# Altium schematic sheet SOC_SUP.SchDoc: Title
size 420 x 297 mm; Author: G.Kasprowicz; CompanyName: WUT ISE; DrawnBy: G.Kasprowicz; Organization: WUT ISE; Address1: PW ISE; Address2: Nowowiejska 15/19 00-665 Warsaw; Address3: gkasprow@gmail.com; DocumentNumber: 19; Revision: 2; SheetNumber: 19; SheetTotal: 40; ModifiedBy: -; CheckedDate: -; Title2: Title 2; DivGrp: WUT ISE; Designer: G.Kasprowicz; ModifiedDate: -; ProjectName: Sensor Box
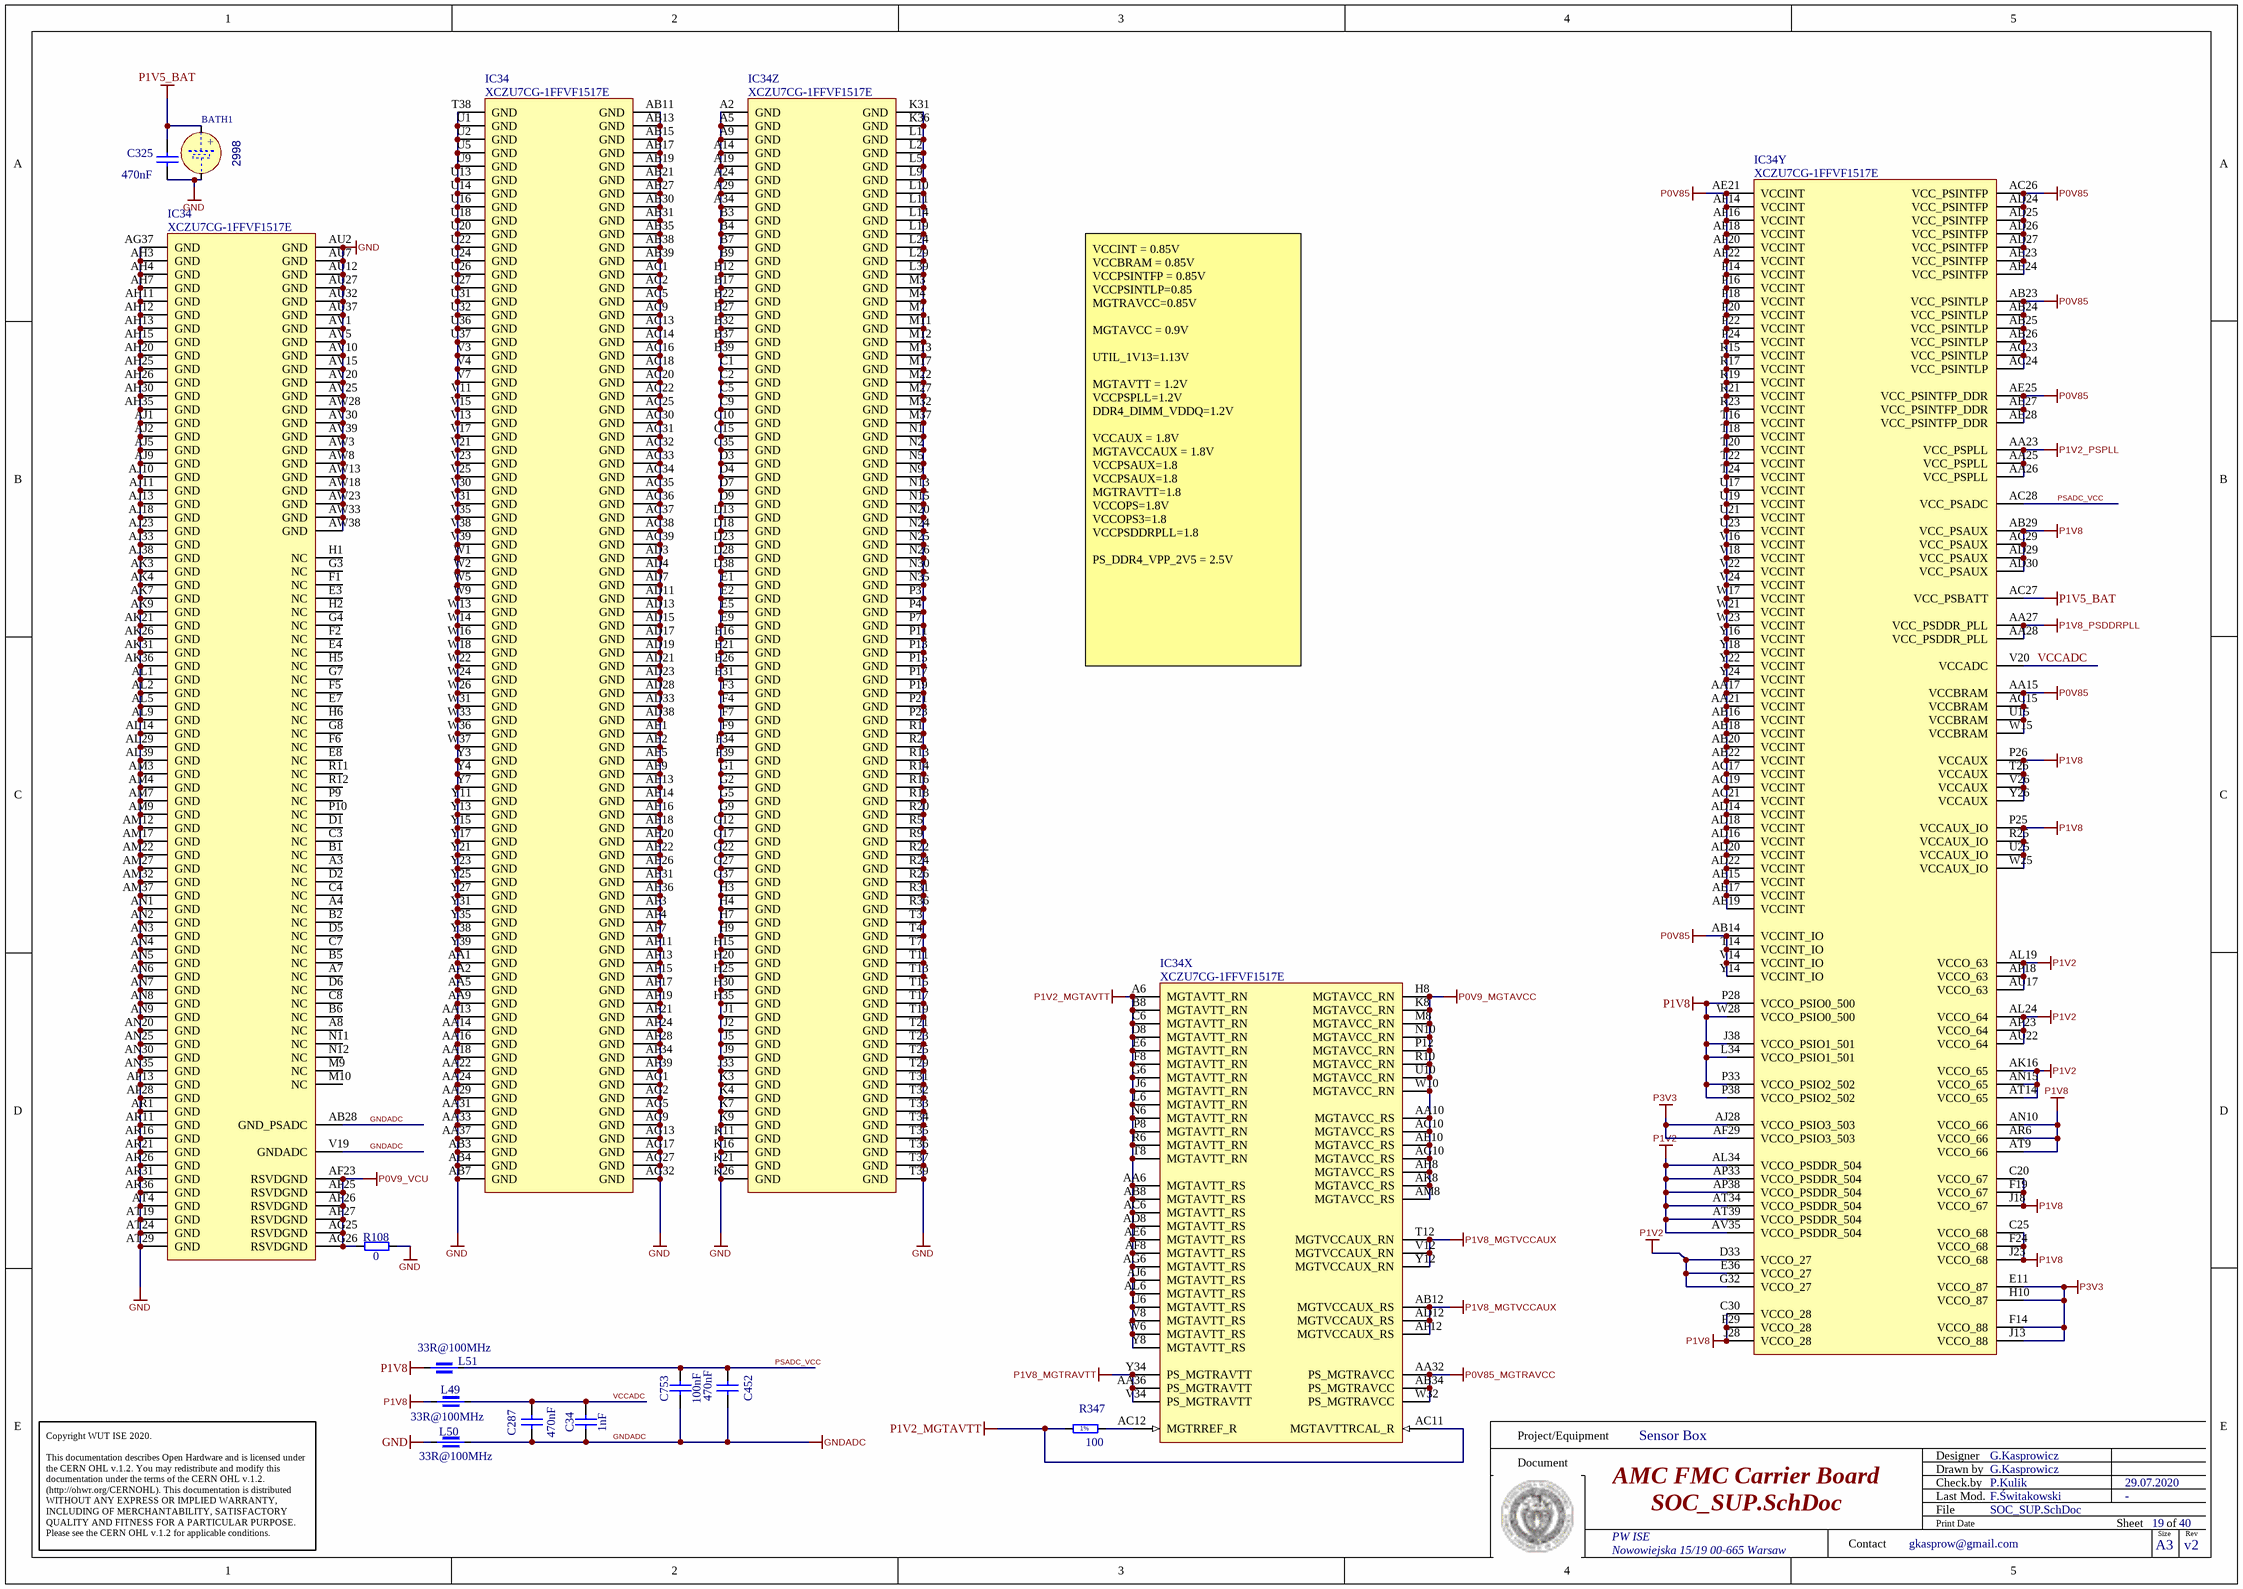
[diagram p0: SOC_SUP.SchDoc]

## Parts
BATH1  Manufacturer Part Number: 2998  [BATH_KEYSTONE_2998]
C34  1nF  [CAPC0603X33N]
C287  470nF  [CAPC0603X33N]
C325  470nF  [CAPC0603X33N]
C452  470nF  [CAPC0603X33N]
C753  100nF  [CAPC1005X55N]
IC34  XCZU7CG-1FFVF1517E  [BGA1517C100P39X39_4000X4000X351]  (parts X,Y,Z,27,28 of 28)
L49  33R@100MHz  [INDC1005X55N]
L50  33R@100MHz  [INDC1005X55N]
L51  33R@100MHz  [INDC1005X55N]
R108  0  [RESC3216X65N]
R347  100  [RESC1005X40N]

## Nets
GND: BATH1.2(MINUS) C325.1 IC34.A2(GND) IC34.A5(GND) IC34.A9(GND) IC34.A14(GND) IC34.A19(GND) IC34.A24(GND) IC34.A29(GND) IC34.A34(GND) IC34.AA1(GND) IC34.AA2(GND) IC34.AA5(GND) IC34.AA9(GND) IC34.AA13(GND) IC34.AA14(GND) IC34.AA16(GND) IC34.AA18(GND) IC34.AA22(GND) IC34.AA24(GND) IC34.AA29(GND) IC34.AA31(GND) IC34.AA33(GND) IC34.AA37(GND) IC34.AB3(GND) IC34.AB4(GND) IC34.AB7(GND) IC34.AB11(GND) IC34.AB13(GND) IC34.AB15(GND) IC34.AB17(GND) IC34.AB19(GND) IC34.AB21(GND) IC34.AB27(GND) IC34.AB30(GND) IC34.AB31(GND) IC34.AB35(GND) IC34.AB38(GND) IC34.AB39(GND) IC34.AC1(GND) IC34.AC2(GND) IC34.AC5(GND) IC34.AC9(GND) IC34.AC13(GND) IC34.AC14(GND) IC34.AC16(GND) IC34.AC18(GND) IC34.AC20(GND) IC34.AC22(GND) IC34.AC25(GND) IC34.AC30(GND) IC34.AC31(GND) IC34.AC32(GND) IC34.AC33(GND) IC34.AC34(GND) IC34.AC35(GND) IC34.AC36(GND) IC34.AC37(GND) IC34.AC38(GND) IC34.AC39(GND) IC34.AD3(GND) IC34.AD4(GND) IC34.AD7(GND) IC34.AD11(GND) IC34.AD13(GND) IC34.AD15(GND) IC34.AD17(GND) IC34.AD19(GND) IC34.AD21(GND) IC34.AD23(GND) IC34.AD28(GND) IC34.AD33(GND) IC34.AD38(GND) IC34.AE1(GND) IC34.AE2(GND) IC34.AE5(GND) IC34.AE9(GND) IC34.AE13(GND) IC34.AE14(GND) IC34.AE16(GND) IC34.AE18(GND) IC34.AE20(GND) IC34.AE22(GND) IC34.AE26(GND) IC34.AE31(GND) IC34.AE36(GND) IC34.AF3(GND) IC34.AF4(GND) IC34.AF7(GND) IC34.AF11(GND) IC34.AF13(GND) IC34.AF15(GND) IC34.AF17(GND) IC34.AF19(GND) IC34.AF21(GND) IC34.AF24(GND) IC34.AF28(GND) IC34.AF34(GND) IC34.AF39(GND) IC34.AG1(GND) IC34.AG2(GND) IC34.AG5(GND) IC34.AG9(GND) IC34.AG13(GND) IC34.AG17(GND) IC34.AG27(GND) IC34.AG32(GND) IC34.AG37(GND) IC34.AH3(GND) IC34.AH4(GND) IC34.AH7(GND) IC34.AH11(GND) IC34.AH12(GND) IC34.AH13(GND) IC34.AH15(GND) IC34.AH20(GND) IC34.AH25(GND) IC34.AH26(GND) IC34.AH30(GND) IC34.AH35(GND) IC34.AJ1(GND) IC34.AJ2(GND) IC34.AJ5(GND) IC34.AJ9(GND) IC34.AJ10(GND) IC34.AJ11(GND) IC34.AJ13(GND) IC34.AJ18(GND) IC34.AJ23(GND) IC34.AJ33(GND) IC34.AJ38(GND) IC34.AK3(GND) IC34.AK4(GND) IC34.AK7(GND) IC34.AK9(GND) IC34.AK21(GND) IC34.AK26(GND) IC34.AK31(GND) IC34.AK36(GND) IC34.AL1(GND) IC34.AL2(GND) IC34.AL5(GND) IC34.AL9(GND) IC34.AL14(GND) IC34.AL29(GND) IC34.AL39(GND) IC34.AM3(GND) IC34.AM4(GND) IC34.AM7(GND) IC34.AM9(GND) IC34.AM12(GND) IC34.AM17(GND) IC34.AM22(GND) IC34.AM27(GND) IC34.AM32(GND) IC34.AM37(GND) IC34.AN1(GND) IC34.AN2(GND) IC34.AN3(GND) IC34.AN4(GND) IC34.AN5(GND) IC34.AN6(GND) IC34.AN7(GND) IC34.AN8(GND) IC34.AN9(GND) IC34.AN20(GND) IC34.AN25(GND) IC34.AN30(GND) IC34.AN35(GND) IC34.AP13(GND) IC34.AP28(GND) IC34.AR1(GND) IC34.AR11(GND) IC34.AR16(GND) IC34.AR21(GND) IC34.AR26(GND) IC34.AR31(GND) IC34.AR36(GND) IC34.AT4(GND) IC34.AT19(GND) IC34.AT24(GND) IC34.AT29(GND) IC34.AU2(GND) IC34.AU7(GND) IC34.AU12(GND) IC34.AU27(GND) IC34.AU32(GND) IC34.AU37(GND) IC34.AV1(GND) IC34.AV5(GND) IC34.AV10(GND) IC34.AV15(GND) IC34.AV20(GND) IC34.AV25(GND) IC34.AV30(GND) IC34.AV39(GND) IC34.AW3(GND) IC34.AW8(GND) IC34.AW13(GND) IC34.AW18(GND) IC34.AW23(GND) IC34.AW28(GND) IC34.AW33(GND) IC34.AW38(GND) IC34.B3(GND) IC34.B4(GND) IC34.B7(GND) IC34.B9(GND) IC34.B12(GND) IC34.B17(GND) IC34.B22(GND) IC34.B27(GND) IC34.B32(GND) IC34.B37(GND) IC34.B39(GND) IC34.C1(GND) IC34.C2(GND) IC34.C5(GND) IC34.C9(GND) IC34.C10(GND) IC34.C15(GND) IC34.C35(GND) IC34.D3(GND) IC34.D4(GND) IC34.D7(GND) IC34.D9(GND) IC34.D13(GND) IC34.D18(GND) IC34.D23(GND) IC34.D28(GND) IC34.D38(GND) IC34.E1(GND) IC34.E2(GND) IC34.E5(GND) IC34.E9(GND) IC34.E16(GND) IC34.E21(GND) IC34.E26(GND) IC34.E31(GND) IC34.F3(GND) IC34.F4(GND) IC34.F7(GND) IC34.F9(GND) IC34.F34(GND) IC34.F39(GND) IC34.G1(GND) IC34.G2(GND) IC34.G5(GND) IC34.G9(GND) IC34.G12(GND) IC34.G17(GND) IC34.G22(GND) IC34.G27(GND) IC34.G37(GND) IC34.H3(GND) IC34.H4(GND) IC34.H7(GND) IC34.H9(GND) IC34.H15(GND) IC34.H20(GND) IC34.H25(GND) IC34.H30(GND) IC34.H35(GND) IC34.J1(GND) IC34.J2(GND) IC34.J5(GND) IC34.J9(GND) IC34.J33(GND) IC34.K3(GND) IC34.K4(GND) IC34.K7(GND) IC34.K9(GND) IC34.K11(GND) IC34.K16(GND) IC34.K21(GND) IC34.K26(GND) IC34.K31(GND) IC34.K36(GND) IC34.L1(GND) IC34.L2(GND) IC34.L5(GND) IC34.L9(GND) IC34.L10(GND) IC34.L11(GND) IC34.L14(GND) IC34.L19(GND) IC34.L24(GND) IC34.L29(GND) IC34.L39(GND) IC34.M3(GND) IC34.M4(GND) IC34.M7(GND) IC34.M11(GND) IC34.M12(GND) IC34.M13(GND) IC34.M17(GND) IC34.M22(GND) IC34.M27(GND) IC34.M32(GND) IC34.M37(GND) IC34.N1(GND) IC34.N2(GND) IC34.N5(GND) IC34.N9(GND) IC34.N13(GND) IC34.N15(GND) IC34.N20(GND) IC34.N24(GND) IC34.N25(GND) IC34.N26(GND) IC34.N30(GND) IC34.N35(GND) IC34.P3(GND) IC34.P4(GND) IC34.P7(GND) IC34.P11(GND) IC34.P13(GND) IC34.P15(GND) IC34.P17(GND) IC34.P19(GND) IC34.P21(GND) IC34.P23(GND) IC34.R1(GND) IC34.R2(GND) IC34.R5(GND) IC34.R9(GND) IC34.R13(GND) IC34.R14(GND) IC34.R16(GND) IC34.R18(GND) IC34.R20(GND) IC34.R22(GND) IC34.R24(GND) IC34.R26(GND) IC34.R31(GND) IC34.R36(GND) IC34.T3(GND) IC34.T4(GND) IC34.T7(GND) IC34.T11(GND) IC34.T13(GND) IC34.T15(GND) IC34.T17(GND) IC34.T19(GND) IC34.T21(GND) IC34.T23(GND) IC34.T25(GND) IC34.T29(GND) IC34.T31(GND) IC34.T32(GND) IC34.T33(GND) IC34.T34(GND) IC34.T35(GND) IC34.T36(GND) IC34.T37(GND) IC34.T38(GND) IC34.T39(GND) IC34.U1(GND) IC34.U2(GND) IC34.U5(GND) IC34.U9(GND) IC34.U13(GND) IC34.U14(GND) IC34.U16(GND) IC34.U18(GND) IC34.U20(GND) IC34.U22(GND) IC34.U24(GND) IC34.U26(GND) IC34.U27(GND) IC34.U31(GND) IC34.U32(GND) IC34.U36(GND) IC34.U37(GND) IC34.V3(GND) IC34.V4(GND) IC34.V7(GND) IC34.V11(GND) IC34.V13(GND) IC34.V15(GND) IC34.V17(GND) IC34.V21(GND) IC34.V23(GND) IC34.V25(GND) IC34.V30(GND) IC34.V31(GND) IC34.V35(GND) IC34.V38(GND) IC34.V39(GND) IC34.W1(GND) IC34.W2(GND) IC34.W5(GND) IC34.W9(GND) IC34.W13(GND) IC34.W14(GND) IC34.W16(GND) IC34.W18(GND) IC34.W22(GND) IC34.W24(GND) IC34.W26(GND) IC34.W31(GND) IC34.W33(GND) IC34.W36(GND) IC34.W37(GND) IC34.Y3(GND) IC34.Y4(GND) IC34.Y7(GND) IC34.Y11(GND) IC34.Y13(GND) IC34.Y15(GND) IC34.Y17(GND) IC34.Y21(GND) IC34.Y23(GND) IC34.Y25(GND) IC34.Y27(GND) IC34.Y31(GND) IC34.Y35(GND) IC34.Y38(GND) IC34.Y39(GND) L50.1 R108.2
GNDADC: C34.1 C287.1 C452.1 C753.1 IC34.AB28(GND_PSADC) IC34.V19(GNDADC) L50.2
P0V9_MGTAVCC: IC34.AA10(MGTAVCC_RS) IC34.AC10(MGTAVCC_RS) IC34.AE10(MGTAVCC_RS) IC34.AG10(MGTAVCC_RS) IC34.AH8(MGTAVCC_RS) IC34.AK8(MGTAVCC_RS) IC34.AM8(MGTAVCC_RS) IC34.H8(MGTAVCC_RN) IC34.K8(MGTAVCC_RN) IC34.M8(MGTAVCC_RN) IC34.N10(MGTAVCC_RN) IC34.P12(MGTAVCC_RN) IC34.R10(MGTAVCC_RN) IC34.U10(MGTAVCC_RN) IC34.W10(MGTAVCC_RN)
P0V9_VCU: IC34.AF23(RSVDGND) IC34.AF25(RSVDGND) IC34.AF26(RSVDGND) IC34.AF27(RSVDGND) IC34.AG25(RSVDGND) IC34.AG26(RSVDGND) R108.1
P0V85: IC34.AA15(VCCBRAM) IC34.AA17(VCCINT) IC34.AA21(VCCINT) IC34.AB14(VCCINT_IO) IC34.AB16(VCCINT) IC34.AB18(VCCINT) IC34.AB20(VCCINT) IC34.AB22(VCCINT) IC34.AB23(VCC_PSINTLP) IC34.AB24(VCC_PSINTLP) IC34.AB25(VCC_PSINTLP) IC34.AB26(VCC_PSINTLP) IC34.AC15(VCCBRAM) IC34.AC17(VCCINT) IC34.AC19(VCCINT) IC34.AC21(VCCINT) IC34.AC23(VCC_PSINTLP) IC34.AC24(VCC_PSINTLP) IC34.AC26(VCC_PSINTFP) IC34.AD14(VCCINT) IC34.AD16(VCCINT) IC34.AD18(VCCINT) IC34.AD20(VCCINT) IC34.AD22(VCCINT) IC34.AD24(VCC_PSINTFP) IC34.AD25(VCC_PSINTFP) IC34.AD26(VCC_PSINTFP) IC34.AD27(VCC_PSINTFP) IC34.AE15(VCCINT) IC34.AE17(VCCINT) IC34.AE19(VCCINT) IC34.AE21(VCCINT) IC34.AE23(VCC_PSINTFP) IC34.AE24(VCC_PSINTFP) IC34.AE25(VCC_PSINTFP_DDR) IC34.AE27(VCC_PSINTFP_DDR) IC34.AE28(VCC_PSINTFP_DDR) IC34.AF14(VCCINT) IC34.AF16(VCCINT) IC34.AF18(VCCINT) IC34.AF20(VCCINT) IC34.AF22(VCCINT) IC34.P14(VCCINT) IC34.P16(VCCINT) IC34.P18(VCCINT) IC34.P20(VCCINT) IC34.P22(VCCINT) IC34.P24(VCCINT) IC34.R15(VCCINT) IC34.R17(VCCINT) IC34.R19(VCCINT) IC34.R21(VCCINT) IC34.R23(VCCINT) IC34.T14(VCCINT_IO) IC34.T16(VCCINT) IC34.T18(VCCINT) IC34.T20(VCCINT) IC34.T22(VCCINT) IC34.T24(VCCINT) IC34.U15(VCCBRAM) IC34.U17(VCCINT) IC34.U19(VCCINT) IC34.U21(VCCINT) IC34.U23(VCCINT) IC34.V14(VCCINT_IO) IC34.V16(VCCINT) IC34.V18(VCCINT) IC34.V22(VCCINT) IC34.V24(VCCINT) IC34.W15(VCCBRAM) IC34.W17(VCCINT) IC34.W21(VCCINT) IC34.W23(VCCINT) IC34.Y14(VCCINT_IO) IC34.Y16(VCCINT) IC34.Y18(VCCINT) IC34.Y22(VCCINT) IC34.Y24(VCCINT)
P0V85_MGTRAVCC: IC34.AA32(PS_MGTRAVCC) IC34.AB34(PS_MGTRAVCC) IC34.W32(PS_MGTRAVCC)
P1V2: IC34.AK16(VCCO_65) IC34.AL19(VCCO_63) IC34.AL24(VCCO_64) IC34.AL34(VCCO_PSDDR_504) IC34.AN15(VCCO_65) IC34.AP18(VCCO_63) IC34.AP23(VCCO_64) IC34.AP33(VCCO_PSDDR_504) IC34.AP38(VCCO_PSDDR_504) IC34.AT14(VCCO_65) IC34.AT34(VCCO_PSDDR_504) IC34.AT39(VCCO_PSDDR_504) IC34.AU17(VCCO_63) IC34.AU22(VCCO_64) IC34.AV35(VCCO_PSDDR_504) IC34.D33(VCCO_27) IC34.E36(VCCO_27) IC34.G32(VCCO_27)
P1V2_MGTAVTT: IC34.A6(MGTAVTT_RN) IC34.AA6(MGTAVTT_RS) IC34.AB8(MGTAVTT_RS) IC34.AC6(MGTAVTT_RS) IC34.AC11(MGTAVTTRCAL_R) IC34.AD8(MGTAVTT_RS) IC34.AE6(MGTAVTT_RS) IC34.AF8(MGTAVTT_RS) IC34.AG6(MGTAVTT_RS) IC34.AJ6(MGTAVTT_RS) IC34.AL6(MGTAVTT_RS) IC34.B8(MGTAVTT_RN) IC34.C6(MGTAVTT_RN) IC34.D8(MGTAVTT_RN) IC34.E6(MGTAVTT_RN) IC34.F8(MGTAVTT_RN) IC34.G6(MGTAVTT_RN) IC34.J6(MGTAVTT_RN) IC34.L6(MGTAVTT_RN) IC34.N6(MGTAVTT_RN) IC34.P8(MGTAVTT_RN) IC34.R6(MGTAVTT_RN) IC34.T8(MGTAVTT_RN) IC34.U6(MGTAVTT_RS) IC34.V8(MGTAVTT_RS) IC34.W6(MGTAVTT_RS) IC34.Y8(MGTAVTT_RS) R347.1
P1V2_PSPLL: IC34.AA23(VCC_PSPLL) IC34.AA25(VCC_PSPLL) IC34.AA26(VCC_PSPLL)
P1V5_BAT: BATH1.1(PLUS) C325.2 IC34.AC27(VCC_PSBATT)
P1V8: IC34.AB29(VCC_PSAUX) IC34.AC29(VCC_PSAUX) IC34.AD29(VCC_PSAUX) IC34.AD30(VCC_PSAUX) IC34.AN10(VCCO_66) IC34.AR6(VCCO_66) IC34.AT9(VCCO_66) IC34.C20(VCCO_67) IC34.C25(VCCO_68) IC34.C30(VCCO_28) IC34.F19(VCCO_67) IC34.F24(VCCO_68) IC34.F29(VCCO_28) IC34.J18(VCCO_67) IC34.J23(VCCO_68) IC34.J28(VCCO_28) IC34.J38(VCCO_PSIO1_501) IC34.L34(VCCO_PSIO1_501) IC34.P25(VCCAUX_IO) IC34.P26(VCCAUX) IC34.P28(VCCO_PSIO0_500) IC34.P33(VCCO_PSIO2_502) IC34.P38(VCCO_PSIO2_502) IC34.R25(VCCAUX_IO) IC34.T26(VCCAUX) IC34.U25(VCCAUX_IO) IC34.V26(VCCAUX) IC34.W25(VCCAUX_IO) IC34.W28(VCCO_PSIO0_500) IC34.Y26(VCCAUX) L49.1 L51.1
P1V8_MGTRAVTT: IC34.AA36(PS_MGTRAVTT) IC34.V34(PS_MGTRAVTT) IC34.Y34(PS_MGTRAVTT)
P1V8_MGTVCCAUX: IC34.AB12(MGTVCCAUX_RS) IC34.AD12(MGTVCCAUX_RS) IC34.AF12(MGTVCCAUX_RS) IC34.T12(MGTVCCAUX_RN) IC34.V12(MGTVCCAUX_RN) IC34.Y12(MGTVCCAUX_RN)
P1V8_PSDDRPLL: IC34.AA27(VCC_PSDDR_PLL) IC34.AA28(VCC_PSDDR_PLL)
P3V3: IC34.AF29(VCCO_PSIO3_503) IC34.AJ28(VCCO_PSIO3_503) IC34.E11(VCCO_87) IC34.F14(VCCO_88) IC34.H10(VCCO_87) IC34.J13(VCCO_88)
PSADC_VCC: C452.2 C753.2 IC34.AC28(VCC_PSADC) L51.2
VCCADC: C34.2 C287.2 IC34.V20(VCCADC) L49.2
NetIC34_AC12: IC34.AC12(MGTRREF_R) R347.2

Not connected (* = marked no-connect by the designer): IC34 A3(NC) A4(NC) A7(NC) A8(NC) B1(NC) B2(NC) B5(NC) B6(NC) C3(NC) C4(NC) C7(NC) C8(NC) D1(NC) D2(NC) D5(NC) D6(NC) E3(NC) E4(NC) E7(NC) E8(NC) F1(NC) F2(NC) F5(NC) F6(NC) G3(NC) G4(NC) G7(NC) G8(NC) H1(NC) H2(NC) H5(NC) H6(NC) M9(NC) M10(NC) N11(NC) N12(NC) P9(NC) P10(NC) R11(NC) R12(NC)

## Notes on the sheet
- VCCINT = 0.85V
  VCCBRAM = 0.85V
  VCCPSINTFP = 0.85V
  VCCPSINTLP=0.85
  MGTRAVCC=0.85V
  MGTAVCC = 0.9V
  UTIL_1V13=1.13V
  MGTAVTT = 1.2V
  VCCPSPLL=1.2V
  DDR4_DIMM_VDDQ=1.2V
  VCCAUX = 1.8V
  MGTAVCCAUX = 1.8V
  VCCPSAUX=1.8
  VCCPSAUX=1.8
  MGTRAVTT=1.8
  VCCOPS=1.8V
  VCCOPS3=1.8
  VCCPSDDRPLL=1.8
  PS_DDR4_VPP_2V5 = 2.5V
- Project/Equipment
- Document
- AMC FMC Carrier Board
- Designer
- Drawn by
- Check.by
- P.Kulik
- 29.07.2020
- Copyright WUT ISE 2020.
  This documentation describes Open Hardware and is licensed under the CERN OHL v.1.2. You may redistribute and modify this documentation under the terms of the CERN OHL v.1.2. (http://ohwr.org/CERNOHL). This documentation is distributed WITHOUT ANY EXPRESS OR IMPLIED WARRANTY, INCLUDING OF MERCHANTABILITY, SATISFACTORY QUALITY AND FITNESS FOR A PARTICULAR PURPOSE. Please see the CERN OHL v.1.2 for applicable conditions.
- Contact
- File
- Last Mod.
- Print Date
- F.Świtakowski
- Sheet
- Size
- A3
- of
- v2
- Rev
- (in symbol BATH_KEYSTONE_2998) +
- (in symbol R0402_100R_1%_0.1W_100PPM) 1%

## Library data of the parts
BATH1 = BATH_KEYSTONE_2998: Battery Holder whit 2 Pin; Part Description: SMD Battery Holder for MC621, V364, SC621, DR13H, DR77, V13AT, 377 Button Cells; PressFit: No; Manufacturer: KEYSTONE; PackageDescription: SMD Battery Holder for MC621, V364, SC621, DR13H, DR77, V13AT, 377 Button Cells; Part Number: BATH_KEYSTONE_2998; Component Kind: Standard; Component Type: Standard; Pin Count: 3; Family: Battery; Mounted: Yes; Socket: No; SMD: Yes; Sense: No; ComponentHeight: 3.048mm; HelpURL: \\cern.ch\dfs\Applications\Altium\Datasheets\BATH_KEYSTONE_2998.pdf; Author: CERN DEM JLC; CreateDate: 03.07.2014; LatestRevisionDate: 07.06.2017
C34 = CC0201_1NF_16V_10%_X5R: Non-polarised capacitor; Part Description: SMD Multilayer Chip Ceramic Capacitor; Manufacturer: GENERIC; Manufacturer1 Part Number: 0201YD102KAT2A; Voltage: 16V; TC: X5R; Tolerance: ±10%; Part Number: CC0201_1NF_16V_10%_X5R; Component Kind: Standard; Component Type: Standard; Pin Count: 2; Value: 1nF; Status: Not Recommended; Manufacturer Part Number: CC0201_1NF_16V_10%_X5R; Case: 0201; Mounted: Yes; Socket: No; SMD: Yes; Sense: No; Manufacturer1 Example: AVX; Manufacturer1 ComponentHeight: 0.33mm; HelpURL: \\cern.ch\dfs\Applications\Altium\Datasheets\CC0201_X5R_AVX.pdf; Author: CERN DEM JLC; CreateDate: 03.12.2007; LatestRevisionDate: 03.12.2007
C287 C325 C452 = CC0201_470NF_4V_20%_X5R: Non-polarised capacitor; Manufacturer: GENERIC; Manufacturer1 Part Number: AMK063BJ474MP-F; Part Description: SMD Multilayer Chip Ceramic Capacitor; TC: X5R; Tolerance: ±20%; Voltage: 4V; Author: CERN DEM JLC; Case: 0201; Component Kind: Standard; Component Type: Standard; CreateDate: 27/05/2010; HelpURL: \\cern.ch\dfs\Applications\Altium\Datasheets\CC0201_X5R_TAIYO-YUDEN_STANDARD-CLASS2.pdf; LatestRevisionDate: 27/05/2010; Manufacturer Part Number: CC0201_470NF_4V_20%_X5R; Manufacturer1 ComponentHeight: 0.33mm; Manufacturer1 Example: TAIYO YUDEN; Mounted: Yes; Part Number: CC0201_470NF_4V_20%_X5R; Pin Count: 2; SMD: Yes; Socket: No; Status: Not Recommended; Value: 470nF; Sense: No
C753 = CC0402_100NF_16V_10%_X7R: Non-polarised capacitor; Part Description: SMD Multilayer Chip Ceramic Capacitor; Manufacturer: GENERIC; Manufacturer1 Part Number: GRM155R71C104KA88D; Voltage: 16V; TC: X7R; Tolerance: ±10%; Part Number: CC0402_100NF_16V_10%_X7R; Component Kind: Standard; Component Type: Standard; Pin Count: 2; Value: 100nF; Status: Not Recommended; Manufacturer Part Number: CC0402_100NF_16V_10%_X7R; Case: 0402; Mounted: Yes; Socket: No; SMD: Yes; Sense: No; Manufacturer1 Example: MURATA; Manufacturer1 ComponentHeight: 0.55mm; HelpURL: \\cern.ch\dfs\Applications\Altium\Datasheets\CC0402_X7R_MURATA_GRM.pdf; Author: CERN DEM JLC; CreateDate: 05/12/2013; LatestRevisionDate: 03/12/2007
IC34 = XCZU7CG-1FFVF1517E: Zynq UltraScale+ RFSoC, Quad-Core ARM® Cortex™-A53 MPCore™ up to 1.5GHz, 214 PS I/O, 416 HP I/O, 48 HD I/O, 1517-Pin BGA; Part Description: Zynq UltraScale+ MPSoC, Quad-Core ARM® Cortex™-A53 MPCore™ up to 1.5GHz, 214 PS I/O, 416 HP I/O, 48 HD I/O, 1517-Pin BGA; Manufacturer: XILINX; PressFit: No; Bonding: No; Part Number: XCZU7CG-1FFVF1517E; Component Kind: Standard; Component Type: Standard; Device: XCZU7CG-1FFVF1517E; PackageDescription: BGA, 1.00mm Pitch, Square; 1517 Pin, 39 Columns X 39 Rows, Body 40.00mm X 40.00mm X 3.51mm H, IPC Medium Density; Manufacturer Part Number: XCZU7CG-1FFVF1517E; Pin Count: 1517; Case: BGA1517; Mounted: Yes; Socket: No; SMD: Yes; Sense: No; ComponentHeight: 3.51mm; HelpURL: \\cern.ch\dfs\Applications\Altium\Datasheets\XCZU7CG-1FFVF1517E.pdf; ComponentLink1URL: \\cern.ch\dfs\Applications\Altium\Datasheets\XCZU7CG-1FFVF1517E_Package-Pinout.pdf; ComponentLink1Description: Package/Pinout; ComponentLink2URL: \\cern.ch\dfs\Applications\Altium\Datasheets\XCZU7CG-1FFVF1517E_Pinout.pdf; ComponentLink2Description: Pinout; Author: CERN DEM BC; CreateDate: 10.07.2019; LatestRevisionDate: 10.07.2019
L49-L51 = IND0402_MURATA_BLM15PX330SN1D: Manufacturer: MURATA; Part Description: SMD EMIFIL Chip Ferrite Bead; Tolerance: ±25%; Power: 3A; Resistance: 0.022R; Manufacturer Part Number: BLM15PX330SN1D; Part Number: IND0402_MURATA_BLM15PX330SN1D; Value: 33R@100MHz; Component Kind: Standard; Component Type: Standard; Pin Count: 2; Status: None; Case: 0402; Mounted: Yes; Socket: No; SMD: Yes; Sense: No; ComponentHeight: 0.55mm; HelpURL: \\cern.ch\dfs\Applications\Altium\Datasheets\IND0402_MURATA_BLM15PX.pdf; Author: CERN DEM JMW; CreateDate: 19/02/2014; LatestRevisionDate: 25/10/2018
R108 = R1206_0R_JUMPER: Resistor; Part Description: 2A (0.05R Max DC Resistance) Zero Ohm Jumper; Manufacturer: GENERIC; Manufacturer1 Part Number: NRC12Z0; PressFit: No; Part Number: R1206_0R_JUMPER; Component Kind: Standard; Component Type: Standard; Pin Count: 2; Value: 0; Status: Preferred; Manufacturer Part Number: R1206_0R_JUMPER; Case: 1206; Mounted: Yes; Sense: No; Socket: No; SMD: Yes; Manufacturer1 Example: NIC COMPONENT; Manufacturer1 ComponentHeight: 0.65mm; HelpURL: \\cern.ch\dfs\Applications\Altium\Datasheets\R1206_NIC_NRC.pdf; Author: CERN DEM JLC; CreateDate: 03.12.2007; LatestRevisionDate: 13.03.2008
R347 = R0402_100R_1%_0.1W_100PPM: Resistor - 1%; Manufacturer Part Number: R0402_100R_1%_0.1W_100PPM_50V; Manufacturer: GENERIC; Part Description: General Purpose Thick Film Chip Resistor; Manufacturer1 Part Number: ERJ2RKF1000X; Power: 0.1W; TC: ±100ppm/°C; Voltage: 50V; PressFit: No; Part Number: R0402_100R_1%_0.1W_100PPM; Tolerance: ±1%; Value: 100; Component Kind: Standard; Component Type: Standard; Pin Count: 2; Status: Not Recommended; Case: 0402; Mounted: Yes; Sense: No; Socket: No; SMD: Yes; Manufacturer1 Example: PANASONIC; Manufacturer1 ComponentHeight: 0.4mm; HelpURL: \\cern.ch\dfs\Applications\Altium\Datasheets\R0402_PANASONIC_ERJ2RK.pdf; Author: CERN DEM JLC; CreateDate: 12/12/2013; LatestRevisionDate: 03/03/2015